# EasyEDA Pro project BLDCv5.eprj, board PCB1
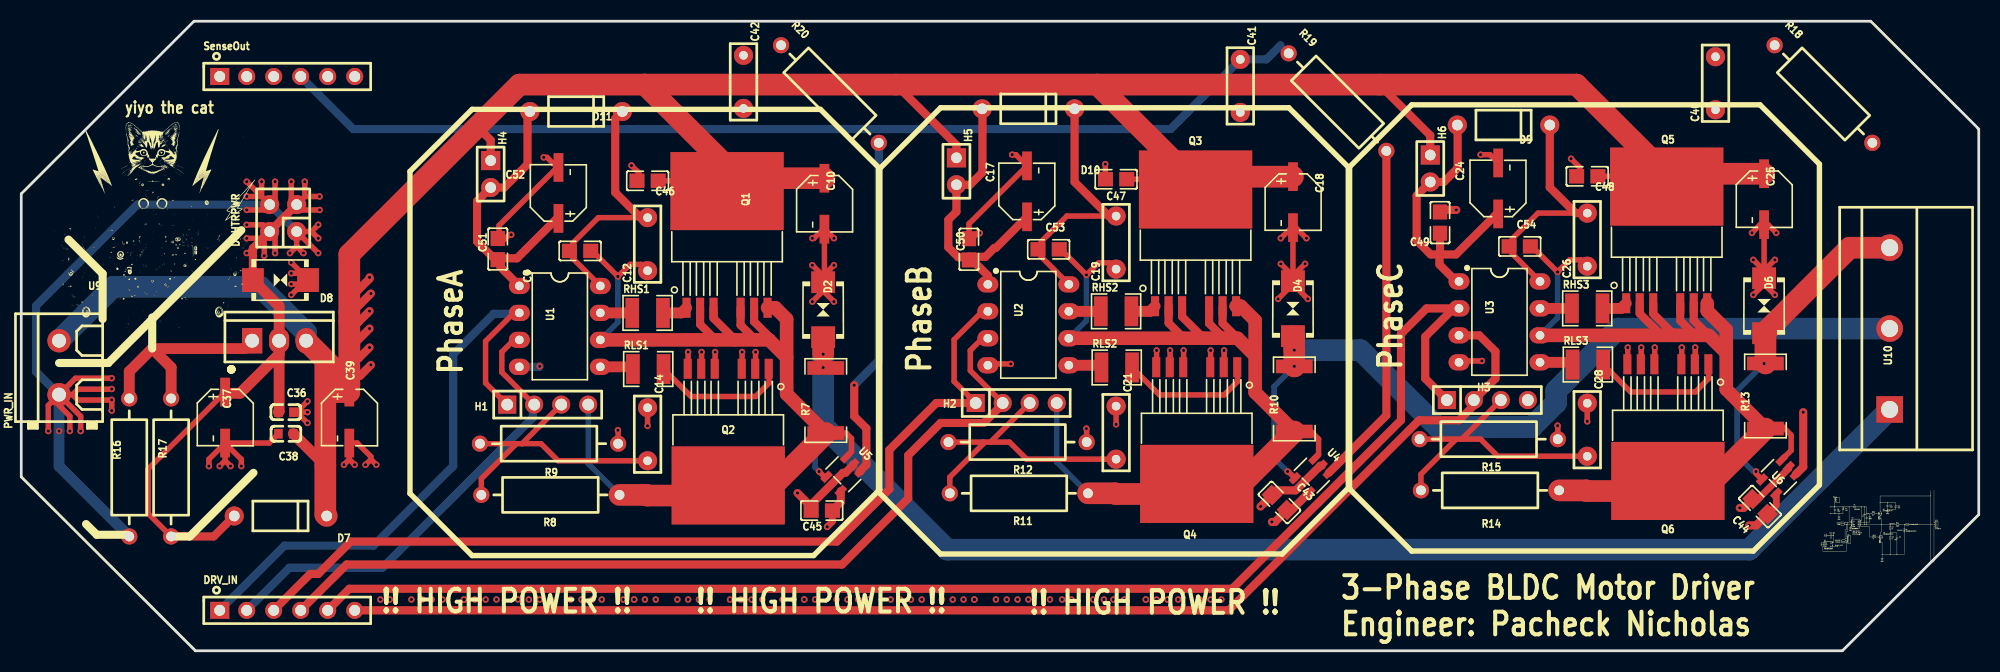
[diagram p8: board, top side]
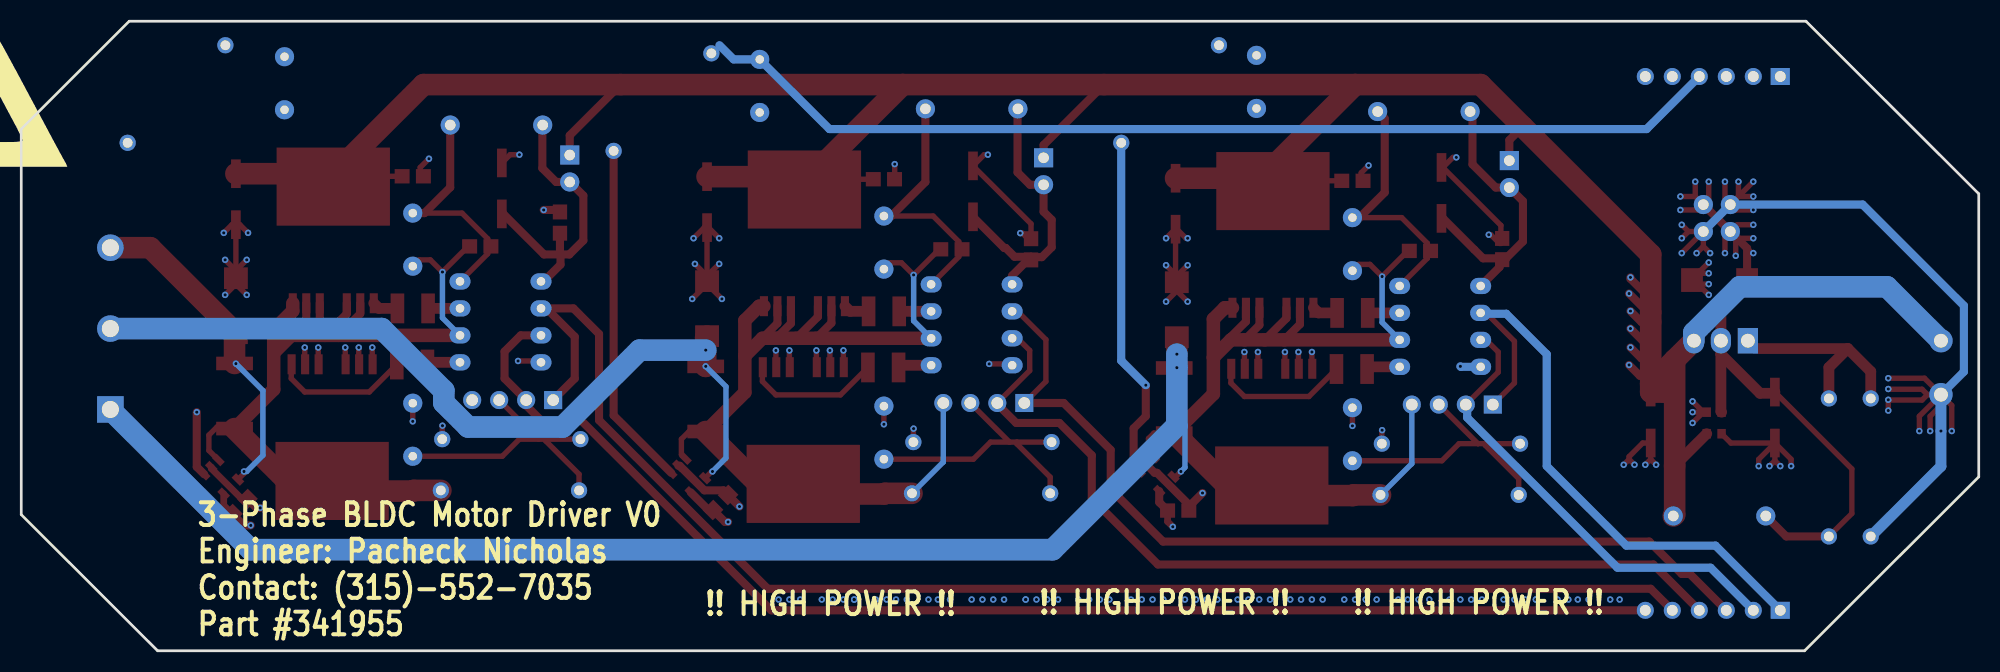
[diagram p9: board, bottom side, seen from below]

Outline 184.15 x 59.31 mm; copper layers: Top Layer, Inner1, Inner2, GND, +5V, Bottom Layer. Coordinates in mm from the lower left corner of the outline.
Outline path: 0,43.05 0,16.38 16.38,0 171.32,0 184.15,12.83 184.15,49.15 173.99,59.31 16.26,59.31 0,43.05
Stack: Top Layer 0.035mm 外层铜厚1oz / Dielectric1 0.0994mm 3313 RC57% 4.2mil / Inner1 0.0152mm 内层铜厚 / Dielectric2 0.55mm 0.55mm H/H不含铜 / Inner2 0.0152mm 内层铜厚 / Dielectric3 0.1088mm 2116 RC54% 4.9mil / GND 0.0152mm 内层铜厚 / Dielectric4 0.55mm 0.55mm H/H不含铜 / +5V 0.0152mm 内层铜厚 / Dielectric5 0.0994mm 3313 RC57% 4.2mil / Bottom Layer 0.035mm 外层铜厚1oz

## Design rules (mm)
template: JLCPCB Capability(Two Layers Board)
spacing copperThickness1oz (default): track to track 0.102, other pairs 0.152 to 0.3
spacing copperThickness2oz: track to track 0.203, other pairs 0.152 to 0.3
track width copperThickness1oz (default): min 0.127, default 0.254, max 2.54
track width copperThickness2oz: min 0.203, default 0.254, max 2.54
differential pair differentialPair (default): width min 0.127, default 0.254, max 2.54; gap min 0.152, default 0.152
via viaSize (default): diameter min 0.5, default 0.61, max 10; hole min 0.3, default 0.305, max 6.3

## Placement (name value [footprint] x y rotation side)
C9  10uF  [CAP-SMD_BD5.0-L5.3-W5.3-LS6.3-FD]  50.54 43.13 90 top
C10  10uF  [CAP-SMD_BD5.0-L5.3-W5.3-LS6.3-FD]  75.56 42.12 270 top
C12  1uF  [CAP-TH_L7.2-W2.5-P5.00-D0.6]  58.92 38.31 90 top
C14  10nF  [CAP-TH_L7.2-W2.5-P5.00-D0.6]  58.92 20.4 270 top
C17  10uF  [CAP-SMD_BD5.0-L5.3-W5.3-LS6.3-FD]  94.61 43.28 90 top
C18  10uF  [CAP-SMD_BD5.0-L5.3-W5.3-LS6.3-FD]  119.63 42.27 270 top
C19  1uF  [CAP-TH_L7.2-W2.5-P5.00-D0.6]  103 38.46 90 top
C21  10nF  [CAP-TH_L7.2-W2.5-P5.00-D0.6]  103 20.55 270 top
C24  10uF  [CAP-SMD_BD5.0-L5.3-W5.3-LS6.3-FD]  138.94 43.56 90 top
C25  10uF  [CAP-SMD_BD5.0-L5.3-W5.3-LS6.3-FD]  163.96 42.54 270 top
C26  1uF  [CAP-TH_L7.2-W2.5-P5.00-D0.6]  147.32 38.73 90 top
C28  10nF  [CAP-TH_L7.2-W2.5-P5.00-D0.6]  147.32 20.83 270 top
C36  500nF  [C0603]  24.89 22.48 0 top
C37  1uF  [CAP-SMD_BD5.0-L5.3-W5.3-LS6.3-FD]  19.18 21.97 270 top
C38  200nF  [C0603]  24.89 20.45 180 top
C39  .1uF  [CAP-SMD_BD5.0-L5.3-W5.3-LS6.3-FD]  30.86 21.97 270 top
C40  10nF  [CAP-TH_L7.2-W2.5-P5.00-D0.6]  159.38 53.47 90 top
C41  10nF  [CAP-TH_L7.2-W2.5-P5.00-D0.6]  114.68 53.21 270 top
C42  10nF  [CAP-TH_L7.2-W2.5-P5.00-D0.6]  67.94 53.59 270 top
C43  100nF  [C0805]  118.36 13.97 135 top
C44  100nF  [C0805]  163.58 13.59 315 top
C45  100nF  [C0805]  75.31 13.21 0 top
C46  100nF  [C0805]  58.92 44.28 180 top
C47  100nF  [C0805]  103 44.43 180 top
C48  100nF  [C0805]  147.32 44.7 180 top
C49  100nF  [C0805]  133.47 40.34 90 top
C50  100nF  [C0805]  89.15 37.82 90 top
C51  100nF  [C0805]  44.83 37.85 90 top
C52  100nF  [C0805]  52.57 37.67 0 top
C53  100nF  [C0805]  96.65 37.82 0 top
C54  100nF  [C0805]  140.97 38.1 0 top
D2  P6SMB6.8CA/TR13  [SMB_L4.6-W3.6-LS5.3-BI]  75.44 32.13 270 top
D4  P6SMB6.8CA/TR13  [SMB_L4.6-W3.6-LS5.3-BI]  119.63 32.23 270 top
D6  P6SMB6.8CA/TR13  [SMB_L4.6-W3.6-LS5.3-BI]  163.96 32.51 270 top
D7  -  [DO-41_BD2.4-L4.7-P8.70-D0.9-RD]  24.38 12.7 180 top
D8  P6SMB6.8CA/TR13  [SMB_L4.6-W3.6-LS5.3-BI]  24.38 34.93 180 top
D9  -  [DO-41_BD2.4-L4.7-P8.70-D0.9-RD]  139.45 49.53 180 top
D10  -  [DO-41_BD2.4-L4.7-P8.70-D0.9-RD]  94.74 51.05 180 top
D11  -  [DO-41_BD2.4-L4.7-P8.70-D0.9-RD]  52.2 50.8 180 top
DGHTRPWR  -  [HDR-TH_4P-P2.54-V-F-R2-C2-S2.54]  24.64 40.77 90 top
DRV_IN  -  [HDR-TH_6P-P2.54-V-F]  25.02 3.81 0 top
H1  -  [HDR-TH_4P-P2.54-V-M]  49.52 23.19 0 top
H2  -  [HDR-TH_4P-P2.54-V-M]  93.6 23.34 0 top
H3  -  [HDR-TH_4P-P2.54-V-M]  137.92 23.62 0 top
H4  -  [HDR-TH_2P-P2.54-V-M-1]  44.16 44.91 270 top
H5  -  [HDR-TH_2P-P2.54-V-M-1]  87.98 45.17 270 top
H6  -  [HDR-TH_2P-P2.54-V-M-1]  132.55 45.44 270 top
PWR_IN  1729128  [CONN-TH_2P-P5.08]  3.56 26.67 90 top
Q1  IRF2804STRL7PP  [D2PAK-7_L10.6-W9.6-P1.27-LS15.9-BR]  66.4 37.81 270 top
Q2  IRF2804STRL7PP  [D2PAK-7_L10.6-W9.6-P1.27-LS15.9-BR]  66.51 21.07 90 top
Q3  IRF2804STRL7PP  [D2PAK-7_L10.6-W9.6-P1.27-LS15.9-BR]  110.47 37.96 270 top
Q4  IRF2804STRL7PP  [D2PAK-7_L10.6-W9.6-P1.27-LS15.9-BR]  110.58 21.22 90 top
Q5  IRF2804STRL7PP  [D2PAK-7_L10.6-W9.6-P1.27-LS15.9-BR]  154.8 38.23 270 top
Q6  IRF2804STRL7PP  [D2PAK-7_L10.6-W9.6-P1.27-LS15.9-BR]  154.91 21.49 90 top
R7  5mΩ  [R2512]  75.69 23.58 90 top
R8  4k  [RES-TH_BD3.3-L9.0-P13.00-D0.6]  49.78 14.69 0 top
R9  1k  [RES-TH_BD3.3-L9.0-P13.00-D0.6]  49.65 19.51 180 top
R10  5mΩ  [R2512]  119.76 23.72 90 top
R11  4k  [RES-TH_BD3.3-L9.0-P13.00-D0.6]  93.85 14.83 0 top
R12  1k  [RES-TH_BD3.3-L9.0-P13.00-D0.6]  93.73 19.66 180 top
R13  5mΩ  [R2512]  164.08 24 90 top
R14  4k  [RES-TH_BD3.3-L9.0-P13.00-D0.6]  138.18 15.11 0 top
R15  1k  [RES-TH_BD3.3-L9.0-P13.00-D0.6]  138.05 19.94 180 top
R16  720  [RES-TH_BD3.3-L9.0-P13.00-D0.6]  10.16 17.27 90 top
R17  240  [RES-TH_BD3.3-L9.0-P13.00-D0.6]  14.1 17.27 270 top
R18  1k  [RES-TH_BD3.3-L9.0-P13.00-D0.6]  169.55 52.45 315 top
R19  1k  [RES-TH_BD3.3-L9.0-P13.00-D0.6]  123.83 51.69 315 top
R20  1k  [RES-TH_BD3.3-L9.0-P13.00-D0.6]  76.07 52.45 315 top
RHS1  10  [R1210]  58.92 31.83 0 top
RHS2  10  [R1210]  103 31.98 0 top
RHS3  10  [R1210]  147.32 32.26 0 top
RLS1  10  [R1210]  58.98 26.54 0 top
RLS2  10  [R1210]  103.06 26.69 0 top
RLS3  10  [R1210]  147.38 26.97 0 top
SenseOut  -  [HDR-TH_6P-P2.54-V-F]  25.02 54.1 0 top
U1  IR2104PBF  [DIP-8_L9.9-W6.6-P2.54-LS7.62-BL]  50.67 30.56 270 top
U2  IR2104PBF  [DIP-8_L9.9-W6.6-P2.54-LS7.62-BL]  94.74 30.71 270 top
U3  IR2104PBF  [DIP-8_L9.9-W6.6-P2.54-LS7.62-BL]  139.06 30.99 270 top
U4  INA180A3IDBVT  [SOT-23-5_L2.9-W1.6-P0.95-LS2.8-TL]  121.41 16.51 225 top
U5  INA180A3IDBVT  [SOT-23-5_L2.9-W1.6-P0.95-LS2.8-TL]  77.34 16.64 225 top
U6  INA180A3IDBVT  [SOT-23-5_L2.9-W1.6-P0.95-LS2.8-TL]  165.35 16.38 225 top
U9  LM317T  [TO-220-3_L10.0-W4.6-P2.54-L]  24.26 29.21 0 top
U10  XY636-7.62-3P  [CONN-TH_XY636-7.62-3P]  175.77 30.35 90 top

## Footprints (pads in the part's own frame, mm; a bottom-side part is the same pattern mirrored in y, then rotated)
C0603
  rect 0.8x0.9 smd: 1(-0.7,0) 2(0.7,0)
C0805
  rect 1.41x1.35 smd: 1(-1,0) 2(1,0)
CAP-SMD_BD5.0-L5.3-W5.3-LS6.3-FD
  rect 2.7x0.91 smd: 1(-2.4,0) 2(2.4,0)
CAP-TH_L7.2-W2.5-P5.00-D0.6
  round 1.8 hole 0.8: 1(-2.499,0) 2(2.499,0)
CONN-TH_2P-P5.08
  round 2.2 hole 1.3: 1(-2.54,0) 2(2.54,0)
CONN-TH_XY636-7.62-3P
  rect 2.5x2.5 hole 1.6: 1(-7.62,0)
  round 2.5 hole 1.6: 2(0,0) 3(7.62,0)
D2PAK-7_L10.6-W9.6-P1.27-LS15.9-BR
  rect 1.887x0.762 smd: 1(5.495,-3.81) 2(5.495,-2.54) 3(5.495,-1.27) 5(5.495,1.27) 6(5.495,2.54) 7(5.495,3.81)
  rect 7.356x10.66 smd: 4(-5.495,0)
DIP-8_L9.9-W6.6-P2.54-LS7.62-BL
  oval 1.524x1.97 hole 0.8: 1(-3.81,-3.81) 2(-1.27,-3.81) 3(1.27,-3.81) 4(3.81,-3.81) 5(3.81,3.81) 6(1.27,3.81) 7(-1.27,3.81) 8(-3.81,3.81)
DO-41_BD2.4-L4.7-P8.70-D0.9-RD
  round 1.8 hole 1: 1(-4.35,0) 2(4.35,0)
HDR-TH_2P-P2.54-V-M-1
  rect 1.8x1.8 hole 1: 1(-1.27,0)
  round 1.8 hole 1: 2(1.27,0)
HDR-TH_4P-P2.54-V-F-R2-C2-S2.54
  round 1.8 hole 1: 1(-1.27,-1.27) 2(-1.27,1.27) 3(1.27,-1.27) 4(1.27,1.27)
HDR-TH_4P-P2.54-V-M
  rect 1.7x1.7 hole 1.1: 1(-3.81,0)
  round 1.7 hole 1.1: 2(-1.27,0) 3(1.27,0) 4(3.81,0)
HDR-TH_6P-P2.54-V-F
  rect 1.8x1.6 hole 1.02: 1(-6.35,0)
  round 1.6 hole 1.02: 2(-3.81,0) 3(-1.27,0) 4(1.27,0) 5(3.81,0) 6(6.35,0)
R1210
  rect 1.282x2.808 smd: 1(-1.441,0) 2(1.441,0)
R2512
  rect 1.282x3.456 smd: 1(-3.067,0) 2(3.067,0)
RES-TH_BD3.3-L9.0-P13.00-D0.6
  round 1.524 hole 0.914: 1(-6.5,0) 2(6.5,0)
SMB_L4.6-W3.6-LS5.3-BI
  rect 2.047x2.241 smd: 1(-2.591,0) 2(2.591,0)
SOT-23-5_L2.9-W1.6-P0.95-LS2.8-TL
  rect 1.1x0.6 smd: 1(-1.3,0.95) 2(-1.3,0) 3(-1.3,-0.95) 4(1.3,-0.95) 5(1.3,0.95)
TO-220-3_L10.0-W4.6-P2.54-L
  rect 1.9x2.4 hole 1.3: 1(-2.54,0)
  oval 1.9x2.4 hole 1.3: 2(0,0) 3(2.54,0)

## Nets
As in the schematic, except:
$1N23730: C26.2 C54.1 D9.1 U3.8

## Via types
v1: diameter 0.61, hole 0.305, Top Layer to Bottom Layer, 187 vias

## Routing (per net, layer and track width the routed paths; a pad name or vN(x,y) marks a point on that pad's centre or on a via; arc(x,y) is an arc through that point)
+5V: length 83.4
  Top Layer w0.508: v1(25.4,44.2) 25.4,42.55 DGHTRPWR.3 ; v1(28.07,41.53) 26.42,41.53 DGHTRPWR.3 ; DGHTRPWR.3 26.67,42.8 ; 26.67,42.8 v1(26.67,44.2) ; 26.67,42.8 v1(28.07,42.8) ; C37.1 11.94,17.13 11.94,12.93 R17.2 ; v1(21.21,37.47) 21.34,37.47 21.79,37.92 ; v1(21.21,40.13) 22.73,40.13 DGHTRPWR.2 23.88,38.99 v1(23.88,37.47) ; 22.73,38.86 v1(21.21,38.86) ; 22.61,38.74 22.86,38.48 v1(22.86,37.21)
  Top Layer w0.635: v1(75.82,11.68) 76.31,12.18 C45.2 ; 164.28,12.88 165.11,13.71 165.11,14.79
  Top Layer w0.762: C45.2 77.1,13.99 U5.5 ; U4.5 119.51,13.26 C43.1 117.94,12.14 v1(117.66,12.14) ; v1(162.56,11.81) 163.21,11.81 164.28,12.88 ; R17.2 18.11,10.77 D7.2 ; D8.2 21.79,37.92 DGHTRPWR.2 DGHTRPWR.3
  Top Layer w1.016: D8.2 24.26,32.46 U9.2 24.26,27.94 ; 24.26,27.94 24.26,22.54 C36.1 ; 24.26,27.94 20.57,24.26 19.29,24.26 C37.1
GND: length 273.2
  Top Layer w0.508: 111.85,26.71 111.89,26.75 v1(111.89,28.3) ; v1(49.15,46.48) 49.46,46.48 50.41,45.53 44.95,40.07 44.95,38.37 ; v1(74.42,36.32) 75.43,35.31 75.43,35.3 ; 163.96,34.54 163.96,35.81 ; 163.96,34.54 v1(162.94,33.53) ; 163.96,34.54 v1(164.97,33.53) ; 27.3,39.5 v1(27.94,38.86) ; 27.3,39.5 v1(27.94,40.13) ; 27.3,39.5 DGHTRPWR.1 ; 32.89,18.03 32.89,18.29 31.61,19.57 C39.2 30.86,18.03 ; 32.89,18.03 v1(32.39,17.53) ; 32.89,18.03 v1(33.4,17.53) ; Q6.6 152.4,27.03 v1(152.4,28.57) ; 26.42,34.54 26.8,34.93 D8.1 ; 26.42,34.54 v1(25.4,34.54) ; 26.42,34.54 v1(25.4,33.53) ; R12.1 100.23,20.91 v1(100.2,20.93) ; v1(17.65,17.4) 17.65,18.05 C37.2 ; v1(5.59,20.7) 5.59,22.1 PWR_IN.1 ; v1(4.57,20.7) 4.57,22.1 3.56,23.11 ; 113.12,26.71 113.16,26.75 v1(113.16,28.3) ; R15.1 144.55,21.18 v1(144.53,21.21) ; DGHTRPWR.4 22.61,42.8 ; DGHTRPWR.4 22.86,41.53 v1(21.21,41.53) ; DGHTRPWR.4 23.88,42.55 v1(23.88,44.2) ; 22.61,42.8 v1(22.61,44.2) ; 22.61,42.8 v1(21.21,44.2) ; 22.61,42.8 v1(21.21,42.8) ; v1(20.7,17.4) 20.7,18.03 19.18,19.56 ; v1(74.42,38.86) 74.58,38.86 75.43,39.72 C10.2 ; 163.96,35.81 v1(164.97,36.83) ; 163.96,35.81 v1(162.94,36.83) ; 163.96,35.81 C25.2 ; v1(64,28.15) 64,26.6 Q2.6 ; v1(30.35,17.53) 30.86,18.03 ; 30.86,18.03 v1(31.37,17.53) ; v1(26.92,23.5) 25.91,22.48 ; 25.91,22.48 C36.2 ; 25.91,22.48 v1(26.92,21.46) ; 25.91,22.48 v1(26.92,22.48) ; DGHTRPWR.1 25.91,38.1 ; DGHTRPWR.1 v1(27.94,37.47) ; 25.91,38.1 v1(26.54,37.47) ; 25.91,38.1 v1(25.27,37.47) ; 109.31,26.71 109.35,26.75 v1(109.35,28.3) ; Q6.5 153.67,27.03 v1(153.67,28.57) ; v1(118.49,36.45) 119.63,35.31 ; 119.63,35.31 v1(120.78,36.45) ; 119.63,35.31 119.63,39.87 ; 119.63,35.31 D4.1 119.63,34.54 ; v1(46.09,39.2) 45.9,39.2 45.08,38.37 ; C10.2 75.6,39.72 v1(76.45,38.86) ; C10.2 75.56,35.43 ; PWR_IN.1 2.54,23.11 v1(2.54,20.7) ; PWR_IN.1 5.1,25.68 v1(8.51,25.68) ; PWR_IN.1 4.83,24.13 ; v1(118.49,38.86) 119.49,39.87 119.63,39.87 ; C38.2 23.32,19.57 C37.2 ; 75.43,35.3 75.56,35.43 ; 75.43,35.3 75.43,33.92 ; v1(19.69,17.4) 19.18,17.91 ; 19.18,17.91 v1(18.67,17.4) ; 19.18,17.91 19.18,19.56 ; v1(137.29,46.74) 138.16,46.74 C24.2 ; 75.43,33.92 v1(76.45,32.89) ; 75.43,33.92 75.43,33.9 v1(74.42,32.89) ; 119.63,34.54 v1(118.24,33.15) ; 119.63,34.54 v1(121.03,33.15) ; 106.77,26.71 106.81,26.75 v1(106.81,28.3) ; v1(8.51,24.66) 8.49,24.64 5.33,24.64 4.83,24.13 ; v1(58.92,21.19) C14.1 ; U3.4 135.38,27.3 v1(137.41,27.3) ; D8.1 26.98,35 v1(25.4,36.58) ; D8.1 26.34,35.56 v1(25.4,35.56) ; 75.56,35.43 75.56,35.31 ; 75.56,35.43 v1(76.45,36.32) ; v1(101.98,45.85) 101.98,44.74 102.3,44.43 ; v1(165.1,39.37) 164.33,40.14 C25.2 ; v1(69.08,28.15) 69.08,26.6 Q2.2 ; 146.62,44.7 146.62,45.53 v1(145.8,46.36) ; C25.2 163.59,40.14 v1(162.81,39.37) ; v1(57.4,45.72) 58.09,45.03 58.09,44.28 ; C37.2 19.18,19.56 ; Q6.2 157.48,27.03 v1(157.48,28.57) ; 4.83,24.13 5.33,23.62 8.49,23.62 v1(8.51,23.65) v1(8.51,22.63) ; 119.63,39.87 119.9,39.87 v1(120.9,38.86) ; 108.04,26.71 108.08,26.75 v1(108.08,28.3) ; v1(67.81,28.15) 67.81,26.6 Q2.3 ; v1(90.17,39.35) 89.98,39.35 89.15,38.52 89.15,40.22 C17.2 93.56,46.74 v1(93.22,46.74) ; Q2.7 62.73,26.6 v1(62.73,28.15) ; Q6.3 156.21,27.03 v1(156.21,28.57) ; Q2.5 65.27,26.6 v1(65.27,28.15) ; v1(103,21.34) C21.1 ; v1(147.32,21.61) 147.32,23.32 ; v1(151.13,28.57) 151.13,27.03 Q6.7 ; v1(93.09,27.03) 91.06,27.03 U2.4 ; R9.1 56.15,20.76 v1(56.13,20.78)
  Top Layer w0.635: 162.87,14.3 163.39,14.3 166.27,17.18 U6.2
  Top Layer w0.762: v1(161.67,13.46) 162.04,13.46 162.87,14.3 ; v1(116.59,13.59) 117.66,14.66 C43.2 118.09,15.11 119.89,15.11 122.2,17.43 U4.2 ; 78.26,17.56 78.26,17.5 77.53,16.76 77.3,16.76 74.18,13.64 ; 74.18,13.21 74.18,13.64 ; 74.18,13.64 74.18,13.7 v1(73.03,14.86) ; v1(135,41.53) 133.66,41.53 C49.2
  Bottom Layer w0.762: PWR_IN.1 1.4,26.29 1.4,32.51 10.92,42.04 DGHTRPWR.4 DGHTRPWR.1 ; U1.4 48.72,26.75 v1(48.77,26.8)
  Bottom Layer w1.016: R16.1 3.56,17.38 v1(3.56,20.7) PWR_IN.1
  vias: v1(33.78,4.83) v1(34.67,4.83) v1(36.7,4.83) v1(37.72,4.83) v1(38.61,4.83) v1(39.62,4.83) v1(41.66,4.83) v1(41.66,4.83) v1(42.67,4.83) v1(43.69,4.83) v1(44.7,4.83) v1(46.74,4.83) v1(47.75,4.83) v1(48.77,4.83) v1(49.78,4.83) v1(51.69,4.83) v1(52.7,4.83) v1(53.72,4.83) v1(54.61,4.83) v1(56.64,4.83) v1(57.66,4.83) v1(57.66,4.83) v1(58.67,4.83) v1(59.69,4.83) v1(61.72,4.83) v1(62.74,4.83) v1(63.75,4.83) v1(64.77,4.83) v1(66.67,4.83) v1(67.69,4.83) v1(68.71,4.83) v1(69.72,4.83) v1(71.63,4.83) v1(72.64,4.83) v1(73.66,4.83) v1(73.66,4.83) v1(74.68,4.83) v1(76.71,4.83) v1(77.72,4.83) v1(78.74,4.83) v1(79.76,4.83) v1(81.79,4.83) v1(82.68,4.83) v1(83.69,4.83) v1(84.71,4.83) v1(86.61,4.83) v1(87.63,4.83) v1(88.65,4.83) v1(89.66,4.83) v1(89.66,4.83) v1(91.69,4.83) v1(92.71,4.83) v1(93.73,4.83) v1(94.74,4.83) v1(96.77,4.83) v1(97.92,4.83) v1(98.81,4.83) v1(100.84,4.83) v1(101.85,4.83) v1(102.74,4.83) v1(103.76,4.83) v1(105.79,4.83) v1(105.79,4.83) v1(106.81,4.83) v1(107.82,4.83) v1(108.84,4.83) v1(110.87,4.83) v1(111.89,4.83) v1(112.9,4.83)
VCC: length 313.6
  Top Layer w0.508: Q5.4 153.83,44.7 148.02,44.7 ; 59.62,44.28 65.43,44.28 Q1.4 ; Q3.4 109.5,44.43 103.7,44.43
  Top Layer w0.762: 82.28,53.34 87.98,47.65 H5.1 ; 31.11,33.4 32.77,35.05 v1(32.77,35.18) ; 30.86,31.88 31.12,31.88 v1(32.89,33.66) ; H6.1 132.55,48.55 127.76,53.34 ; 31.5,28.58 31.5,29.08 v1(32.77,30.35) ; 42.89,49.37 44.16,48.1 H4.1 ; 31.75,25.91 31.88,25.91 v1(32.89,26.92) ; v1(32.77,28.58) 31.75,27.56 31.62,27.56 ; 30.86,30.97 31.73,30.97 v1(32.77,32)
  Top Layer w1.016: C38.1 28.61,17.43
  Top Layer w2.032: 28.61,27.4 30.86,25.15 ; 28.61,27.4 28.61,12.83 D7.1 ; 28.61,27.4 U9.3 ; 30.86,25.15 C39.1 29.6,24.37 29.34,24.64 ; 30.86,25.15 30.86,37.34 46.86,53.34 58.66,53.34 ; C10.1 67.61,44.52 Q1.4 ; 110.79,43.77 101.22,53.34 ; 110.79,43.77 Q3.4 ; 110.79,43.77 111.68,44.67 C18.1 ; 101.22,53.34 146.3,53.34 154.7,44.94 156.01,44.94 ; 101.22,53.34 58.66,53.34 ; 156.01,44.94 C25.1 ; 156.01,44.94 Q5.4 ; 58.66,53.34 67.48,44.52
  Bottom Layer w2.032: PWR_IN.2 8.64,34.29 22.48,34.29 26.8,29.97 U9.3
HI_IN1: length 56.9
  Top Layer w0.508: H1.1 43.68,25.23 43.68,29.16 46.35,31.83 U1.2
  Bottom Layer w0.762: 46.73,31.83 46.65,31.75 44.45,31.75 40.64,27.94 40.64,17.4 33.15,9.91 24.77,9.91 DRV_IN.1
HI_IN2: length 87.4
  Top Layer w0.508: H2.1 87.76,25.38 87.76,29.31 90.42,31.98 U2.2
  Top Layer w0.762: H2.1 86.08,23.34 81.66,18.92 81.66,15.22 76.73,10.29 30.99,10.29 27.94,7.24 27.18,7.24 DRV_IN.3
HI_IN3: length 133.6
  Top Layer w0.762: 134.75,32.26 U3.2 ; 134.75,32.26 132.08,29.59 132.08,25.65 H3.1 ; 134.75,32.26 132.2,32.26 129.79,29.85 129.79,21.72 113.92,5.84 30.86,5.84 DRV_IN.5
ISENSE1: length 98.3
  Top Layer w0.508: 53.27,37.67 53.71,37.67 v1(56.13,35.26) 57.27,36.4 58.33,36.4 C12.1 ; R7.1 75.69,21.02 ; R7.1 75.56,20.51 ; R7.1 77.6,20.51 78.11,20 78.11,18.74 U5.3
  Top Layer w0.762: 69.06,29.29 67.67,30.69 Q1.5 ; 70.35,29.29 70.35,29.6 68.94,31.01 Q1.6 ; 67.16,29.29 65.13,31.32 Q1.3 ; Q1.2 63.86,30.76 65.33,29.29
  Top Layer w1.27: 72,27.64 72,24.19 R7.1 ; 72,27.64 70.35,29.29 U1.6 ; 72,27.64 72,31.25 70.94,32.31 Q1.7
  Top Layer w2.032: R7.1 70.75,15.57 Q2.4 65.55,14.62 58.88,14.62 58.82,14.69 R8.2
  Bottom Layer w0.508: R8.2 53.33,17.63 H1.4 ; U1.6 56.13,30.94 v1(56.13,35.26)
ISENSE2: length 98
  Top Layer w0.508: C19.1 102.4,36.55 101.35,36.55 v1(100.2,35.41) 97.79,37.82 97.35,37.82 ; 119.76,21.17 R10.1 121.33,20.66 122.05,19.94 122.05,18.49 U4.3
  Top Layer w0.762: 111.24,29.44 109.2,31.47 Q3.3 ; 109.37,29.44 107.93,30.88 Q3.2 ; 113.14,29.44 111.74,30.84 Q3.5 ; 114.43,29.44 113.01,30.85 Q3.6
  Top Layer w1.27: R10.1 116.08,24.34 116.08,27.79 ; 116.08,27.79 114.43,29.44 U2.6 ; 116.08,27.79 116.08,31.12 114.73,32.46 Q3.7
  Top Layer w2.032: R10.1 114.83,15.72 Q4.4 109.63,14.77 102.96,14.77 102.89,14.83 R11.2
  Bottom Layer w0.508: v1(100.2,35.41) 100.2,31.09 U2.6 ; R11.2 97.41,17.78 H2.4
ISENSE3: length 98.9
  Top Layer w0.508: 164.08,21.44 R13.1 164.23,21.08 165.74,21.08 166.5,20.32 166.5,18.87 165.6,17.97 ; 141.67,38.1 142.11,38.1 v1(144.53,35.68) 145.67,36.83 146.73,36.83 C26.1
  Top Layer w0.762: Q5.2 152.26,31.77 154.31,29.72 ; Q5.6 157.34,31.13 158.75,29.72 ; 157.46,29.72 156.07,31.11 Q5.5 ; 155.56,29.72 153.53,31.75 Q5.3
  Top Layer w1.27: Q5.7 158.61,32.02 160.4,30.23 160.4,28.06 ; R13.1 160.4,24.62 160.4,28.06 ; 160.4,28.06 158.75,29.72 U3.6
  Top Layer w2.032: R13.1 159.15,16 Q6.4 153.95,15.05 147.28,15.05 147.22,15.11 R14.2
  Inner2 w0.508: R14.2 141.73,18.05 H3.4
  Bottom Layer w0.508: v1(144.53,35.68) 144.53,31.37 U3.6
ISENSE_AMP1: length 51.5
  Inner2 w0.762: SenseOut.2 23.2,56.09 C42.1 70.52,56.09 R20.1
ISENSE_AMP2: length 97.5
  Bottom Layer w0.762: 118.47,57.05 117.13,55.71 C41.1 108.12,49.15 31.24,49.15 SenseOut.4
ISENSE_AMP3: length 134.8
  Inner1 w0.762: SenseOut.6 157.52,54.1 C40.2 160.47,57.05 R18.1
PHASE_OUT1: length 125.2
  Top Layer w0.508: 75.56,26.64 75.47,26.64 v1(75.44,26.67) ; v1(75.06,16.89) 75.56,16.39 U5.4
  Top Layer w2.032: 75.43,29.49 75.44,29.49 v1(75.44,27.94)
  Bottom Layer w0.508: 75.18,21.72 74.68,21.21 74.68,17.27 v1(75.06,16.89)
  Bottom Layer w2.032: v1(75.44,27.94) v1(75.44,26.67) 75.44,21.21 87.12,9.53 162.56,9.53 U10.1
PHASE_OUT2: length 78.6
  Top Layer w0.508: v1(119.13,16.89) 119.19,16.89 U4.4
  Top Layer w2.032: R10.2 v1(119.76,26.8) v1(119.76,28.32) 119.76,29.51 D4.2
  Bottom Layer w0.508: v1(119.76,26.8) 117.86,24.89 117.86,18.16 v1(119.13,16.89)
  Bottom Layer w2.032: v1(119.76,28.32) 125.98,28.32 133.22,21.08 142.11,21.08 144.4,23.37 144.4,24.51 150.24,30.35 U10.2
PHASE_OUT3: length 31.3
  Top Layer w0.508: U6.4 163.19,16.7 v1(163.19,16.89) ; R13.2 164.07,27.05 v1(163.96,27.05)
  Top Layer w2.032: R13.2 164.08,29.79 D6.2 172.01,37.97 U10.3
  Bottom Layer w0.508: v1(163.96,27.05) 161.42,24.51 161.42,18.42 162.94,16.89 v1(163.19,16.89)
SD#1: length 44
  Top Layer w0.508: H1.2 45.21,26.24 45.21,28.15 46.35,29.29 U1.3
  Bottom Layer w0.762: 48.13,23.19 48.13,21.96 33.99,7.82 25.22,7.82 DRV_IN.2
SD#2: length 84.9
  Top Layer w0.508: U2.3 90.42,29.44 89.28,28.3 89.28,26.39 H2.2
  Top Layer w0.762: H2.2 92.33,23.24 90.55,21.46 86.49,21.46 83.44,18.42 83.44,14.35 77.22,8.13 30.61,8.13 DRV_IN.4
SD#3: length 123.3
  Top Layer w0.762: DRV_IN.6 113.59,3.81 131.5,21.72 135.25,21.72 136.65,23.11 H3.2 138.68,25.65 138.68,28.19 137.16,29.72 U3.3
VSENSE1: length 72.9
  Top Layer w0.508: 47.11,19.51 H1.3 ; 47.11,19.51 48.89,19.51 50.5,17.9 C14.2 ; 47.11,19.51 46.42,19.51 ; 43.28,15.19 43.28,16.21 46.42,19.35 46.42,19.51 ; R9.2 46.42,19.51
  Inner2 w0.762: R9.2 41.58,19.51 34.42,26.67 34.42,38.35 SenseOut.1
VSENSE2: length 114.9
  Top Layer w0.508: 87.35,15.34 87.35,16.36 90.49,19.5 90.49,19.66 ; 91.19,19.66 90.49,19.66 ; 91.19,19.66 92.96,19.66 94.57,18.05 C21.2 ; 91.19,19.66 H2.3 ; 90.49,19.66 R12.2
  Inner2 w0.762: R12.2 78.36,28.53 78.36,45.47 74.68,49.15 28.7,49.15 SenseOut.3
VSENSE3: length 156
  Top Layer w0.508: 134.82,19.94 134.82,19.77 131.68,16.63 131.68,15.62 ; 134.82,19.94 135.51,19.94 ; 134.82,19.94 R15.2 ; 135.51,19.94 137.29,19.94 138.9,18.33 C28.2 ; 135.51,19.94 H3.3
  Inner2 w0.762: SenseOut.5 30.35,52.58 119.13,52.58 126.75,44.96 126.75,24.74 R15.2
$1N695: length 3
  Top Layer w1.016: U1.7 RHS1.1
$1N696: length 2.4
  Top Layer w1.016: Q1.1 62.1,31.83 RHS1.2
$1N697: length 3.1
  Top Layer w1.016: U1.5 57.33,26.75 RLS1.1
$1N698: length 12.9
  Top Layer w0.508: Q2.1 70.35,26.53 70.35,25.23 69.08,23.96 63.01,23.96 RLS1.2
$1N719: length 24.6
  Top Layer w0.508: U1.8 51.87,36.98 51.87,37.67 ; 51.74,37.8 51.87,37.67 ; 51.87,37.67 51.87,38.39 54.29,40.81 58.25,40.81
  Top Layer w0.762: C12.2 58.25,40.81 55.88,43.18 55.88,50.13 D11.1
$1N1386: length 3
  Top Layer w1.016: U2.7 RHS2.1
$1N1387: length 2.4
  Top Layer w1.016: RHS2.2 106.18,31.98 Q3.1
$1N1388: length 3.1
  Top Layer w1.016: U2.5 101.41,26.9 RLS2.1
$1N1389: length 12.9
  Top Layer w0.508: 114.39,26.71 114.43,26.68 114.43,25.38 113.16,24.11 107.08,24.11 RLS2.2
$1N1402: length 27.8
  Top Layer w0.762: D10.2 90.42,51.02 90.42,45.07 89.26,43.9 H5.2 87.98,41.37 87.21,40.6 87.21,38.01 88.14,37.08 89.12,37.08 89.15,37.12 ; 89.15,37.12 90.93,35.34 U2.1 ; 89.15,37.12 90.71,37.12 91.54,37.95 91.68,37.95 C17.1
$1N1410: length 24.6
  Top Layer w0.508: U2.8 95.95,37.12 95.95,38.54 98.36,40.96 102.3,40.96
  Top Layer w0.762: D10.1 99.09,44.16 102.3,40.96 C19.2
$1N2077: length 3
  Top Layer w1.016: U3.7 RHS3.1
$1N2078: length 2.4
  Top Layer w1.016: Q5.1 150.5,32.26 RHS3.2
$1N2079: length 3.2
  Top Layer w1.016: U3.5 145.73,27.18 RLS3.1
$1N2080: length 12.9
  Top Layer w0.508: RLS3.2 151.41,24.38 157.48,24.38 158.75,25.65 158.75,26.96 Q6.1
$1N11632: length 20.7
  Top Layer w1.016: R16.2 10.16,26.31 12.32,28.47 ; 12.32,28.47 20.98,28.47 U9.1 ; 12.32,28.47 14.1,26.69 R17.1
$1N15082: length 32.6
  Top Layer w0.762: R19.2 128.42,22.18 U4.1
$1N15123: length 34.2
  Top Layer w0.762: v1(167.64,22.48) 167.64,17.33 U6.1
  Inner1 w0.762: R18.2 174.14,44.86 167.64,38.35 v1(167.64,22.48)
$1N19803: length 32.6
  Top Layer w0.762: 78.93,16.88 78.93,16.96 79.5,17.53 79.5,20.96 78.36,22.1 v1(78.36,25.02)
  Bottom Layer w0.762: R20.2 80.67,27.33 v1(78.36,25.02)
$1N19890: length 28.3
  Top Layer w0.762: 45.08,36.97 44.47,36.97 42.88,38.56 42.88,42.36 H4.2 45.44,43.64 47.62,45.83 47.62,50.58 D11.2 ; 45.08,36.97 45.08,36.15 U1.1 ; 45.08,36.97 46.64,36.97 50.4,40.73 C9.1
$1N23718: length 28.5
  Top Layer w0.762: 138.94,41.16 138.79,41.16 134.97,37.34 133.42,37.34 ; 133.42,37.34 133.42,36.38 135,34.8 U3.1 ; 133.42,37.34 133.47,37.39 ; 133.42,37.34 132.59,37.34 131.27,38.66 131.27,42.88 H6.2 133.83,44.17 135.13,45.46 135.13,49.5 D9.2 ; 133.47,37.39 133.48,37.4 ; 133.47,37.39 C49.1
$1N23730: length 22.5
  Top Layer w0.508: U3.8 140.27,37.4 140.27,38.82 142.69,41.23 146.22,41.23
  Top Layer w0.762: C26.2 146.22,41.23 143.8,43.66 D9.1

## Copper pours and planes (outline as drawn; the poured copper is in the pictures)
+5V on +5V: 0.26,59.05 183.89,59.05 183.89,0.26 0.26,0.26
GND on GND: 0.26,59.05 183.89,59.05 183.89,0.26 0.26,0.26

Small or netless copper shapes (teardrops, artwork), in the pictures only: 64 on GND, 20 on +5V

## Text on the board
Bottom Silkscreen Layer: !! HIGH POWER !! | 3-Phase BLDC Motor Driver V0 / Engineer: Pacheck Nicholas / Contact: (315)-552-7035 / Part #341955
Top Silkscreen Layer: yiyo the cat | !! HIGH POWER !! | 3-Phase BLDC Motor Driver / Engineer: Pacheck Nicholas | PhaseA | PhaseB | PhaseC
